# EAGLE schematic Resistor_Resistor (EAGLE 8.3.0), part 25 of 43
## Parts (continued)
R34378  10K  RESISTOR_0201  [0201]
R34379  10K  RESISTOR_0201  [0201]
R34380  10K  RESISTOR_0201  [0201]
R34381  10K  RESISTOR_0201  [0201]
R34382  10K  RESISTOR_0201  [0201]
R34383  10K  RESISTOR_0201  [0201]
R34384  10K  RESISTOR_0201  [0201]
R34385  10K  RESISTOR_0201  [0201]
R34386  10K  RESISTOR_0201  [0201]
R34387  10K  RESISTOR_0201  [0201]
R34388  10K  RESISTOR_0201  [0201]
R34389  10K  RESISTOR_0201  [0201]
R34390  10K  RESISTOR_0201  [0201]
R34391  10K  RESISTOR_0201  [0201]
R34392  10K  RESISTOR_0201  [0201]
R34393  10K  RESISTOR_0201  [0201]
R34394  10K  RESISTOR_0201  [0201]
R34395  10K  RESISTOR_0201  [0201]
R34396  10K  RESISTOR_0201  [0201]
R34397  10K  RESISTOR_0201  [0201]
R34398  10K  RESISTOR_0201  [0201]
R34399  10K  RESISTOR_0201  [0201]
R34400  10K  RESISTOR_0201  [0201]
R34401  10K  RESISTOR_0201  [0201]
R34402  10K  RESISTOR_0201  [0201]
R34403  10K  RESISTOR_0201  [0201]
R34404  10K  RESISTOR_0201  [0201]
R34405  10K  RESISTOR_0201  [0201]
R34406  10K  RESISTOR_0201  [0201]
R34407  10K  RESISTOR_0201  [0201]
R34408  10K  RESISTOR_0201  [0201]
R34409  10K  RESISTOR_0201  [0201]
R34410  10K  RESISTOR_0201  [0201]
R34411  10K  RESISTOR_0201  [0201]
R34412  10K  RESISTOR_0201  [0201]
R34413  10K  RESISTOR_0201  [0201]
R34414  10K  RESISTOR_0201  [0201]
R34415  10K  RESISTOR_0201  [0201]
R34416  10K  RESISTOR_0201  [0201]
R34417  10K  RESISTOR_0201  [0201]
R34418  10K  RESISTOR_0201  [0201]
R34419  10K  RESISTOR_0201  [0201]
R34420  10K  RESISTOR_0201  [0201]
R34421  10K  RESISTOR_0201  [0201]
R34422  10K  RESISTOR_0201  [0201]
R34423  10K  RESISTOR_0201  [0201]
R34424  10K  RESISTOR_0201  [0201]
R34425  10K  RESISTOR_0201  [0201]
R34426  10K  RESISTOR_0201  [0201]
R34427  10K  RESISTOR_0201  [0201]
R34428  10K  RESISTOR_0201  [0201]
R34429  10K  RESISTOR_0201  [0201]
R34430  10K  RESISTOR_0201  [0201]
R34431  10K  RESISTOR_0201  [0201]
R34432  10K  RESISTOR_0201  [0201]
R34433  10K  RESISTOR_0201  [0201]
R34434  10K  RESISTOR_0201  [0201]
R34435  10K  RESISTOR_0201  [0201]
R34436  10K  RESISTOR_0201  [0201]
R34437  10K  RESISTOR_0201  [0201]
R34438  10K  RESISTOR_0201  [0201]
R34439  10K  RESISTOR_0201  [0201]
R34440  10K  RESISTOR_0201  [0201]
R34441  10K  RESISTOR_0201  [0201]
R34442  10K  RESISTOR_0201  [0201]
R34443  10K  RESISTOR_0201  [0201]
R34444  10K  RESISTOR_0201  [0201]
R34445  10K  RESISTOR_0201  [0201]
R34446  10K  RESISTOR_0201  [0201]
R34447  10K  RESISTOR_0201  [0201]
R34448  10K  RESISTOR_0201  [0201]
R34449  10K  RESISTOR_0201  [0201]
R34450  10K  RESISTOR_0201  [0201]
R34451  10K  RESISTOR_0201  [0201]
R34452  10K  RESISTOR_0201  [0201]
R34453  10K  RESISTOR_0201  [0201]
R34454  10K  RESISTOR_0201  [0201]
R34455  10K  RESISTOR_0201  [0201]
R34456  10K  RESISTOR_0201  [0201]
R34457  10K  RESISTOR_0201  [0201]
R34458  10K  RESISTOR_0201  [0201]
R34459  10K  RESISTOR_0201  [0201]
R34460  10K  RESISTOR_0201  [0201]
R34461  10K  RESISTOR_0201  [0201]
R34462  10K  RESISTOR_0201  [0201]
R34463  10K  RESISTOR_0201  [0201]
R34464  10K  RESISTOR_0201  [0201]
R34465  10K  RESISTOR_0201  [0201]
R34466  10K  RESISTOR_0201  [0201]
R34467  10K  RESISTOR_0201  [0201]
R34468  10K  RESISTOR_0201  [0201]
R34469  10K  RESISTOR_0201  [0201]
R34470  10K  RESISTOR_0201  [0201]
R34471  10K  RESISTOR_0201  [0201]
R34472  10K  RESISTOR_0201  [0201]
R34473  10K  RESISTOR_0201  [0201]
R34474  10K  RESISTOR_0201  [0201]
R34475  10K  RESISTOR_0201  [0201]
R34476  10K  RESISTOR_0201  [0201]
R34477  10K  RESISTOR_0201  [0201]
R34478  10K  RESISTOR_0201  [0201]
R34479  10K  RESISTOR_0201  [0201]
R34480  10K  RESISTOR_0201  [0201]
R34481  10K  RESISTOR_0201  [0201]
R34482  10K  RESISTOR_0201  [0201]
R34483  10K  RESISTOR_0201  [0201]
R34484  10K  RESISTOR_0201  [0201]
R34485  10K  RESISTOR_0201  [0201]
R34486  10K  RESISTOR_0201  [0201]
R34487  10K  RESISTOR_0201  [0201]
R34488  10K  RESISTOR_0201  [0201]
R34489  10K  RESISTOR_0201  [0201]
R34490  10K  RESISTOR_0201  [0201]
R34491  10K  RESISTOR_0201  [0201]
R34492  10K  RESISTOR_0201  [0201]
R34493  10K  RESISTOR_0201  [0201]
R34494  10K  RESISTOR_0201  [0201]
R34495  10K  RESISTOR_0201  [0201]
R34496  10K  RESISTOR_0201  [0201]
R34497  10K  RESISTOR_0201  [0201]
R34498  10K  RESISTOR_0201  [0201]
R34499  10K  RESISTOR_0201  [0201]
R34500  10K  RESISTOR_0201  [0201]
R34501  10K  RESISTOR_0201  [0201]
R34502  10K  RESISTOR_0201  [0201]
R34503  10K  RESISTOR_0201  [0201]
R34504  10K  RESISTOR_0201  [0201]
R34505  10K  RESISTOR_0201  [0201]
R34506  10K  RESISTOR_0201  [0201]
R34507  10K  RESISTOR_0201  [0201]
R34508  10K  RESISTOR_0201  [0201]
R34509  10K  RESISTOR_0201  [0201]
R34510  10K  RESISTOR_0201  [0201]
R34511  10K  RESISTOR_0201  [0201]
R34512  10K  RESISTOR_0201  [0201]
R34513  10K  RESISTOR_0201  [0201]
R34514  10K  RESISTOR_0201  [0201]
R34515  10K  RESISTOR_0201  [0201]
R34516  10K  RESISTOR_0201  [0201]
R34517  10K  RESISTOR_0201  [0201]
R34518  10K  RESISTOR_0201  [0201]
R34519  10K  RESISTOR_0201  [0201]
R34520  10K  RESISTOR_0201  [0201]
R34521  10K  RESISTOR_0201  [0201]
R34522  10K  RESISTOR_0201  [0201]
R34523  10K  RESISTOR_0201  [0201]
R34524  10K  RESISTOR_0201  [0201]
R34525  10K  RESISTOR_0201  [0201]
R34526  10K  RESISTOR_0201  [0201]
R34527  10K  RESISTOR_0201  [0201]
R34528  10K  RESISTOR_0201  [0201]
R34529  10K  RESISTOR_0201  [0201]
R34530  10K  RESISTOR_0201  [0201]
R34531  10K  RESISTOR_0201  [0201]
R34532  10K  RESISTOR_0201  [0201]
R34533  10K  RESISTOR_0201  [0201]
R34534  10K  RESISTOR_0201  [0201]
R34535  10K  RESISTOR_0201  [0201]
R34536  10K  RESISTOR_0201  [0201]
R34537  10K  RESISTOR_0201  [0201]
R34538  10K  RESISTOR_0201  [0201]
R34539  10K  RESISTOR_0201  [0201]
R34540  10K  RESISTOR_0201  [0201]
R34541  10K  RESISTOR_0201  [0201]
R34542  10K  RESISTOR_0201  [0201]
R34543  10K  RESISTOR_0201  [0201]
R34544  10K  RESISTOR_0201  [0201]
R34545  10K  RESISTOR_0201  [0201]
R34546  10K  RESISTOR_0201  [0201]
R34547  10K  RESISTOR_0201  [0201]
R34548  10K  RESISTOR_0201  [0201]
R34549  10K  RESISTOR_0201  [0201]
R34550  10K  RESISTOR_0201  [0201]
R34551  10K  RESISTOR_0201  [0201]
R34552  10K  RESISTOR_0201  [0201]
R34553  10K  RESISTOR_0201  [0201]
R34554  10K  RESISTOR_0201  [0201]
R34555  10K  RESISTOR_0201  [0201]
R34556  10K  RESISTOR_0201  [0201]
R34557  10K  RESISTOR_0201  [0201]
R34558  10K  RESISTOR_0201  [0201]
R34559  10K  RESISTOR_0201  [0201]
R34560  10K  RESISTOR_0201  [0201]
R34561  10K  RESISTOR_0201  [0201]
R34562  10K  RESISTOR_0201  [0201]
R34563  10K  RESISTOR_0201  [0201]
R34564  10K  RESISTOR_0201  [0201]
R34565  10K  RESISTOR_0201  [0201]
R34566  10K  RESISTOR_0201  [0201]
R34567  10K  RESISTOR_0201  [0201]
R34568  10K  RESISTOR_0201  [0201]
R34569  10K  RESISTOR_0201  [0201]
R34570  10K  RESISTOR_0201  [0201]
R34571  10K  RESISTOR_0201  [0201]
R34572  10K  RESISTOR_0201  [0201]
R34573  10K  RESISTOR_0201  [0201]
R34574  10K  RESISTOR_0201  [0201]
R34575  10K  RESISTOR_0201  [0201]
R34576  10K  RESISTOR_0201  [0201]
R34577  10K  RESISTOR_0201  [0201]
R34578  10K  RESISTOR_0201  [0201]
R34579  10K  RESISTOR_0201  [0201]
R34580  10K  RESISTOR_0201  [0201]
R34581  10K  RESISTOR_0201  [0201]
R34582  10K  RESISTOR_0201  [0201]
R34583  10K  RESISTOR_0201  [0201]
R34584  10K  RESISTOR_0201  [0201]
R34585  10K  RESISTOR_0201  [0201]
R34586  10K  RESISTOR_0201  [0201]
R34587  10K  RESISTOR_0201  [0201]
R34588  10K  RESISTOR_0201  [0201]
R34589  10K  RESISTOR_0201  [0201]
R34590  10K  RESISTOR_0201  [0201]
R34591  10K  RESISTOR_0201  [0201]
R34592  10K  RESISTOR_0201  [0201]
R34593  10K  RESISTOR_0201  [0201]
R34594  10K  RESISTOR_0201  [0201]
R34595  10K  RESISTOR_0201  [0201]
R34596  10K  RESISTOR_0201  [0201]
R34597  10K  RESISTOR_0201  [0201]
R34598  10K  RESISTOR_0201  [0201]
R34599  10K  RESISTOR_0201  [0201]
R34600  10K  RESISTOR_0201  [0201]
R34601  10K  RESISTOR_0201  [0201]
R34602  10K  RESISTOR_0201  [0201]
R34603  10K  RESISTOR_0201  [0201]
R34604  10K  RESISTOR_0201  [0201]
R34605  10K  RESISTOR_0201  [0201]
R34606  10K  RESISTOR_0201  [0201]
R34607  10K  RESISTOR_0201  [0201]
R34608  10K  RESISTOR_0201  [0201]
R34609  10K  RESISTOR_0201  [0201]
R34610  10K  RESISTOR_0201  [0201]
R34611  10K  RESISTOR_0201  [0201]
R34612  10K  RESISTOR_0201  [0201]
R34613  10K  RESISTOR_0201  [0201]
R34614  10K  RESISTOR_0201  [0201]
R34615  10K  RESISTOR_0201  [0201]
R34616  10K  RESISTOR_0201  [0201]
R34617  10K  RESISTOR_0201  [0201]
R34618  10K  RESISTOR_0201  [0201]
R34619  10K  RESISTOR_0201  [0201]
R34620  10K  RESISTOR_0201  [0201]
R34621  10K  RESISTOR_0201  [0201]
R34622  10K  RESISTOR_0201  [0201]
R34623  10K  RESISTOR_0201  [0201]
R34624  10K  RESISTOR_0201  [0201]
R34625  10K  RESISTOR_0201  [0201]
R34626  10K  RESISTOR_0201  [0201]
R34627  10K  RESISTOR_0201  [0201]
R34628  10K  RESISTOR_0201  [0201]
R34629  10K  RESISTOR_0201  [0201]
R34630  10K  RESISTOR_0201  [0201]
R34631  10K  RESISTOR_0201  [0201]
R34632  10K  RESISTOR_0201  [0201]
R34633  10K  RESISTOR_0201  [0201]
R34634  10K  RESISTOR_0201  [0201]
R34635  10K  RESISTOR_0201  [0201]
R34636  10K  RESISTOR_0201  [0201]
R34637  10K  RESISTOR_0201  [0201]
R34638  10K  RESISTOR_0201  [0201]
R34639  10K  RESISTOR_0201  [0201]
R34640  10K  RESISTOR_0201  [0201]
R34641  10K  RESISTOR_0201  [0201]
R34642  10K  RESISTOR_0201  [0201]
R34643  10K  RESISTOR_0201  [0201]
R34644  10K  RESISTOR_0201  [0201]
R34645  10K  RESISTOR_0201  [0201]
R34646  10K  RESISTOR_0201  [0201]
R34647  10K  RESISTOR_0201  [0201]
R34648  10K  RESISTOR_0201  [0201]
R34649  10K  RESISTOR_0201  [0201]
R34650  10K  RESISTOR_0201  [0201]
R34651  10K  RESISTOR_0201  [0201]
R34652  10K  RESISTOR_0201  [0201]
R34653  10K  RESISTOR_0201  [0201]
R34654  10K  RESISTOR_0201  [0201]
R34655  10K  RESISTOR_0201  [0201]
R34656  10K  RESISTOR_0201  [0201]
R34657  10K  RESISTOR_0201  [0201]
R34658  10K  RESISTOR_0201  [0201]
R34659  10K  RESISTOR_0201  [0201]
R34660  10K  RESISTOR_0201  [0201]
R34661  10K  RESISTOR_0201  [0201]
R34662  10K  RESISTOR_0201  [0201]
R34663  10K  RESISTOR_0201  [0201]
R34664  10K  RESISTOR_0201  [0201]
R34665  10K  RESISTOR_0201  [0201]
R34666  10K  RESISTOR_0201  [0201]
R34667  10K  RESISTOR_0201  [0201]
R34668  10K  RESISTOR_0201  [0201]
R34669  10K  RESISTOR_0201  [0201]
R34670  10K  RESISTOR_0201  [0201]
R34671  10K  RESISTOR_0201  [0201]
R34672  10K  RESISTOR_0201  [0201]
R34673  10K  RESISTOR_0201  [0201]
R34674  10K  RESISTOR_0201  [0201]
R34675  10K  RESISTOR_0201  [0201]
R34676  10K  RESISTOR_0201  [0201]
R34677  10K  RESISTOR_0201  [0201]
R34678  10K  RESISTOR_0201  [0201]
R34679  10K  RESISTOR_0201  [0201]
R34680  10K  RESISTOR_0201  [0201]
R34681  10K  RESISTOR_0201  [0201]
R34682  10K  RESISTOR_0201  [0201]
R34683  10K  RESISTOR_0201  [0201]
R34684  10K  RESISTOR_0201  [0201]
R34685  10K  RESISTOR_0201  [0201]
R34686  10K  RESISTOR_0201  [0201]
R34687  10K  RESISTOR_0201  [0201]
R34688  10K  RESISTOR_0201  [0201]
R34689  10K  RESISTOR_0201  [0201]
R34690  10K  RESISTOR_0201  [0201]
R34691  10K  RESISTOR_0201  [0201]
R34692  10K  RESISTOR_0201  [0201]
R34693  10K  RESISTOR_0201  [0201]
R34694  10K  RESISTOR_0201  [0201]
R34695  10K  RESISTOR_0201  [0201]
R34696  10K  RESISTOR_0201  [0201]
R34697  10K  RESISTOR_0201  [0201]
R34698  10K  RESISTOR_0201  [0201]
R34699  10K  RESISTOR_0201  [0201]
R34700  10K  RESISTOR_0201  [0201]
R34701  10K  RESISTOR_0201  [0201]
R34702  10K  RESISTOR_0201  [0201]
R34703  10K  RESISTOR_0201  [0201]
R34704  10K  RESISTOR_0201  [0201]
R34705  10K  RESISTOR_0201  [0201]
R34706  10K  RESISTOR_0201  [0201]
R34707  10K  RESISTOR_0201  [0201]
R34708  10K  RESISTOR_0201  [0201]
R34709  10K  RESISTOR_0201  [0201]
R34710  10K  RESISTOR_0201  [0201]
R34711  10K  RESISTOR_0201  [0201]
R34712  10K  RESISTOR_0201  [0201]
R34713  10K  RESISTOR_0201  [0201]
R34714  10K  RESISTOR_0201  [0201]
R34715  10K  RESISTOR_0201  [0201]
R34716  10K  RESISTOR_0201  [0201]
R34717  10K  RESISTOR_0201  [0201]
R34718  10K  RESISTOR_0201  [0201]
R34719  10K  RESISTOR_0201  [0201]
R34720  10K  RESISTOR_0201  [0201]
R34721  10K  RESISTOR_0201  [0201]
R34722  10K  RESISTOR_0201  [0201]
R34723  10K  RESISTOR_0201  [0201]
R34724  10K  RESISTOR_0201  [0201]
R34725  10K  RESISTOR_0201  [0201]
R34726  10K  RESISTOR_0201  [0201]
R34727  10K  RESISTOR_0201  [0201]
R34728  10K  RESISTOR_0201  [0201]
R34729  10K  RESISTOR_0201  [0201]
R34730  10K  RESISTOR_0201  [0201]
R34731  10K  RESISTOR_0201  [0201]
R34732  10K  RESISTOR_0201  [0201]
R34733  10K  RESISTOR_0201  [0201]
R34734  10K  RESISTOR_0201  [0201]
R34735  10K  RESISTOR_0201  [0201]
R34736  10K  RESISTOR_0201  [0201]
R34737  10K  RESISTOR_0201  [0201]
R34738  10K  RESISTOR_0201  [0201]
R34739  10K  RESISTOR_0201  [0201]
R34740  10K  RESISTOR_0201  [0201]
R34741  10K  RESISTOR_0201  [0201]
R34742  10K  RESISTOR_0201  [0201]
R34743  10K  RESISTOR_0201  [0201]
R34744  10K  RESISTOR_0201  [0201]
R34745  10K  RESISTOR_0201  [0201]
R34746  10K  RESISTOR_0201  [0201]
R34747  10K  RESISTOR_0201  [0201]
R34748  10K  RESISTOR_0201  [0201]
R34749  10K  RESISTOR_0201  [0201]
R34750  10K  RESISTOR_0201  [0201]
R34751  10K  RESISTOR_0201  [0201]
R34752  10K  RESISTOR_0201  [0201]
R34753  10K  RESISTOR_0201  [0201]
R34754  10K  RESISTOR_0201  [0201]
R34755  10K  RESISTOR_0201  [0201]
R34756  10K  RESISTOR_0201  [0201]
R34757  10K  RESISTOR_0201  [0201]
R34758  10K  RESISTOR_0201  [0201]
R34759  10K  RESISTOR_0201  [0201]
R34760  10K  RESISTOR_0201  [0201]
R34761  10K  RESISTOR_0201  [0201]
R34762  10K  RESISTOR_0201  [0201]
R34763  10K  RESISTOR_0201  [0201]
R34764  10K  RESISTOR_0201  [0201]
R34765  10K  RESISTOR_0201  [0201]
R34766  10K  RESISTOR_0201  [0201]
R34767  10K  RESISTOR_0201  [0201]
R34768  10K  RESISTOR_0201  [0201]
R34769  10K  RESISTOR_0201  [0201]
R34770  10K  RESISTOR_0201  [0201]
R34771  10K  RESISTOR_0201  [0201]
R34772  10K  RESISTOR_0201  [0201]
R34773  10K  RESISTOR_0201  [0201]
R34774  10K  RESISTOR_0201  [0201]
R34775  10K  RESISTOR_0201  [0201]
R34776  10K  RESISTOR_0201  [0201]
R34777  10K  RESISTOR_0201  [0201]
R34778  10K  RESISTOR_0201  [0201]
R34779  10K  RESISTOR_0201  [0201]
R34780  10K  RESISTOR_0201  [0201]
R34781  10K  RESISTOR_0201  [0201]
R34782  10K  RESISTOR_0201  [0201]
R34783  10K  RESISTOR_0201  [0201]
R34784  10K  RESISTOR_0201  [0201]
R34785  10K  RESISTOR_0201  [0201]
R34786  10K  RESISTOR_0201  [0201]
R34787  10K  RESISTOR_0201  [0201]
R34788  10K  RESISTOR_0201  [0201]
R34789  10K  RESISTOR_0201  [0201]
R34790  10K  RESISTOR_0201  [0201]
R34791  10K  RESISTOR_0201  [0201]
R34792  10K  RESISTOR_0201  [0201]
R34793  10K  RESISTOR_0201  [0201]
R34794  10K  RESISTOR_0201  [0201]
R34795  10K  RESISTOR_0201  [0201]
R34796  10K  RESISTOR_0201  [0201]
R34797  10K  RESISTOR_0201  [0201]
R34798  10K  RESISTOR_0201  [0201]
R34799  10K  RESISTOR_0201  [0201]
R34800  10K  RESISTOR_0201  [0201]
R34801  10K  RESISTOR_0201  [0201]
R34802  10K  RESISTOR_0201  [0201]
R34803  10K  RESISTOR_0201  [0201]
R34804  10K  RESISTOR_0201  [0201]
R34805  10K  RESISTOR_0201  [0201]
R34806  10K  RESISTOR_0201  [0201]
R34807  10K  RESISTOR_0201  [0201]
R34808  10K  RESISTOR_0201  [0201]
R34809  10K  RESISTOR_0201  [0201]
R34810  10K  RESISTOR_0201  [0201]
R34811  10K  RESISTOR_0201  [0201]
R34812  10K  RESISTOR_0201  [0201]
R34813  10K  RESISTOR_0201  [0201]
R34814  10K  RESISTOR_0201  [0201]
R34815  10K  RESISTOR_0201  [0201]
R34816  10K  RESISTOR_0201  [0201]
R34817  10K  RESISTOR_0201  [0201]
R34818  10K  RESISTOR_0201  [0201]
R34819  10K  RESISTOR_0201  [0201]
R34820  10K  RESISTOR_0201  [0201]
R34821  10K  RESISTOR_0201  [0201]
R34822  10K  RESISTOR_0201  [0201]
R34823  10K  RESISTOR_0201  [0201]
R34824  10K  RESISTOR_0201  [0201]
R34825  10K  RESISTOR_0201  [0201]
R34826  10K  RESISTOR_0201  [0201]
R34827  10K  RESISTOR_0201  [0201]
R34828  10K  RESISTOR_0201  [0201]
R34829  10K  RESISTOR_0201  [0201]
R34830  10K  RESISTOR_0201  [0201]
R34831  10K  RESISTOR_0201  [0201]
R34832  10K  RESISTOR_0201  [0201]
R34833  10K  RESISTOR_0201  [0201]
R34834  10K  RESISTOR_0201  [0201]
R34835  10K  RESISTOR_0201  [0201]
R34836  10K  RESISTOR_0201  [0201]
R34837  10K  RESISTOR_0201  [0201]
R34838  10K  RESISTOR_0201  [0201]
R34839  10K  RESISTOR_0201  [0201]
R34840  10K  RESISTOR_0201  [0201]
R34841  10K  RESISTOR_0201  [0201]
R34842  10K  RESISTOR_0201  [0201]
R34843  10K  RESISTOR_0201  [0201]
R34844  10K  RESISTOR_0201  [0201]
R34845  10K  RESISTOR_0201  [0201]
R34846  10K  RESISTOR_0201  [0201]
R34847  10K  RESISTOR_0201  [0201]
R34848  10K  RESISTOR_0201  [0201]
R34849  10K  RESISTOR_0201  [0201]
R34850  10K  RESISTOR_0201  [0201]
R34851  10K  RESISTOR_0201  [0201]
R34852  10K  RESISTOR_0201  [0201]
R34853  10K  RESISTOR_0201  [0201]
R34854  10K  RESISTOR_0201  [0201]
R34855  10K  RESISTOR_0201  [0201]
R34856  10K  RESISTOR_0201  [0201]
R34857  10K  RESISTOR_0201  [0201]
R34858  10K  RESISTOR_0201  [0201]
R34859  10K  RESISTOR_0201  [0201]
R34860  10K  RESISTOR_0201  [0201]
R34861  10K  RESISTOR_0201  [0201]
R34862  10K  RESISTOR_0201  [0201]
R34863  10K  RESISTOR_0201  [0201]
R34864  10K  RESISTOR_0201  [0201]
R34865  10K  RESISTOR_0201  [0201]
R34866  10K  RESISTOR_0201  [0201]
R34867  10K  RESISTOR_0201  [0201]
R34868  10K  RESISTOR_0201  [0201]
R34869  10K  RESISTOR_0201  [0201]
R34870  10K  RESISTOR_0201  [0201]
R34871  10K  RESISTOR_0201  [0201]
R34872  10K  RESISTOR_0201  [0201]
R34873  10K  RESISTOR_0201  [0201]
R34874  10K  RESISTOR_0201  [0201]
R34875  10K  RESISTOR_0201  [0201]
R34876  10K  RESISTOR_0201  [0201]
R34877  10K  RESISTOR_0201  [0201]
R34878  10K  RESISTOR_0201  [0201]
R34879  10K  RESISTOR_0201  [0201]
R34880  10K  RESISTOR_0201  [0201]
R34881  10K  RESISTOR_0201  [0201]
R34882  10K  RESISTOR_0201  [0201]
R34883  10K  RESISTOR_0201  [0201]
R34884  10K  RESISTOR_0201  [0201]
R34885  10K  RESISTOR_0201  [0201]
R34886  10K  RESISTOR_0201  [0201]
R34887  10K  RESISTOR_0201  [0201]
R34888  10K  RESISTOR_0201  [0201]
R34889  10K  RESISTOR_0201  [0201]
R34890  10K  RESISTOR_0201  [0201]
R34891  10K  RESISTOR_0201  [0201]
R34892  10K  RESISTOR_0201  [0201]
R34893  10K  RESISTOR_0201  [0201]
R34894  10K  RESISTOR_0201  [0201]
R34895  10K  RESISTOR_0201  [0201]
R34896  10K  RESISTOR_0201  [0201]
R34897  10K  RESISTOR_0201  [0201]
R34898  10K  RESISTOR_0201  [0201]
R34899  10K  RESISTOR_0201  [0201]
R34900  10K  RESISTOR_0201  [0201]
R34901  10K  RESISTOR_0201  [0201]
R34902  10K  RESISTOR_0201  [0201]
R34903  10K  RESISTOR_0201  [0201]
R34904  10K  RESISTOR_0201  [0201]
R34905  10K  RESISTOR_0201  [0201]
R34906  10K  RESISTOR_0201  [0201]
R34907  10K  RESISTOR_0201  [0201]
R34908  10K  RESISTOR_0201  [0201]
R34909  10K  RESISTOR_0201  [0201]
R34910  10K  RESISTOR_0201  [0201]
R34911  10K  RESISTOR_0201  [0201]
R34912  10K  RESISTOR_0201  [0201]
R34913  10K  RESISTOR_0201  [0201]
R34914  10K  RESISTOR_0201  [0201]
R34915  10K  RESISTOR_0201  [0201]
R34916  10K  RESISTOR_0201  [0201]
R34917  10K  RESISTOR_0201  [0201]
R34918  10K  RESISTOR_0201  [0201]
R34919  10K  RESISTOR_0201  [0201]
R34920  10K  RESISTOR_0201  [0201]
R34921  10K  RESISTOR_0201  [0201]
R34922  10K  RESISTOR_0201  [0201]
R34923  10K  RESISTOR_0201  [0201]
R34924  10K  RESISTOR_0201  [0201]
R34925  10K  RESISTOR_0201  [0201]
R34926  10K  RESISTOR_0201  [0201]
R34927  10K  RESISTOR_0201  [0201]
R34928  10K  RESISTOR_0201  [0201]
R34929  10K  RESISTOR_0201  [0201]
R34930  10K  RESISTOR_0201  [0201]
R34931  10K  RESISTOR_0201  [0201]
R34932  10K  RESISTOR_0201  [0201]
R34933  10K  RESISTOR_0201  [0201]
R34934  10K  RESISTOR_0201  [0201]
R34935  10K  RESISTOR_0201  [0201]
R34936  10K  RESISTOR_0201  [0201]
R34937  10K  RESISTOR_0201  [0201]
R34938  10K  RESISTOR_0201  [0201]
R34939  10K  RESISTOR_0201  [0201]
R34940  10K  RESISTOR_0201  [0201]
R34941  10K  RESISTOR_0201  [0201]
R34942  10K  RESISTOR_0201  [0201]
R34943  10K  RESISTOR_0201  [0201]
R34944  10K  RESISTOR_0201  [0201]
R34945  10K  RESISTOR_0201  [0201]
R34946  10K  RESISTOR_0201  [0201]
R34947  10K  RESISTOR_0201  [0201]
R34948  10K  RESISTOR_0201  [0201]
R34949  10K  RESISTOR_0201  [0201]
R34950  10K  RESISTOR_0201  [0201]
R34951  10K  RESISTOR_0201  [0201]
R34952  10K  RESISTOR_0201  [0201]
R34953  10K  RESISTOR_0201  [0201]
R34954  10K  RESISTOR_0201  [0201]
R34955  10K  RESISTOR_0201  [0201]
R34956  10K  RESISTOR_0201  [0201]
R34957  10K  RESISTOR_0201  [0201]
R34958  10K  RESISTOR_0201  [0201]
R34959  10K  RESISTOR_0201  [0201]
R34960  10K  RESISTOR_0201  [0201]
R34961  10K  RESISTOR_0201  [0201]
R34962  10K  RESISTOR_0201  [0201]
R34963  10K  RESISTOR_0201  [0201]
R34964  10K  RESISTOR_0201  [0201]
R34965  10K  RESISTOR_0201  [0201]
R34966  10K  RESISTOR_0201  [0201]
R34967  10K  RESISTOR_0201  [0201]
R34968  10K  RESISTOR_0201  [0201]
R34969  10K  RESISTOR_0201  [0201]
R34970  10K  RESISTOR_0201  [0201]
R34971  10K  RESISTOR_0201  [0201]
R34972  10K  RESISTOR_0201  [0201]
R34973  10K  RESISTOR_0201  [0201]
R34974  10K  RESISTOR_0201  [0201]
R34975  10K  RESISTOR_0201  [0201]
R34976  10K  RESISTOR_0201  [0201]
R34977  10K  RESISTOR_0201  [0201]
R34978  10K  RESISTOR_0201  [0201]
R34979  10K  RESISTOR_0201  [0201]
R34980  10K  RESISTOR_0201  [0201]
R34981  10K  RESISTOR_0201  [0201]
R34982  10K  RESISTOR_0201  [0201]
R34983  10K  RESISTOR_0201  [0201]
R34984  10K  RESISTOR_0201  [0201]
R34985  10K  RESISTOR_0201  [0201]
R34986  10K  RESISTOR_0201  [0201]
R34987  10K  RESISTOR_0201  [0201]
R34988  10K  RESISTOR_0201  [0201]
R34989  10K  RESISTOR_0201  [0201]
R34990  10K  RESISTOR_0201  [0201]
R34991  10K  RESISTOR_0201  [0201]
R34992  10K  RESISTOR_0201  [0201]
R34993  10K  RESISTOR_0201  [0201]
R34994  10K  RESISTOR_0201  [0201]
R34995  10K  RESISTOR_0201  [0201]
R34996  10K  RESISTOR_0201  [0201]
R34997  10K  RESISTOR_0201  [0201]
R34998  10K  RESISTOR_0201  [0201]
R34999  10K  RESISTOR_0201  [0201]
R35000  10K  RESISTOR_0201  [0201]
R35001  10K  RESISTOR_0201  [0201]
R35002  10K  RESISTOR_0201  [0201]
R35003  10K  RESISTOR_0201  [0201]
R35004  10K  RESISTOR_0201  [0201]
R35005  10K  RESISTOR_0201  [0201]
R35006  10K  RESISTOR_0201  [0201]
R35007  10K  RESISTOR_0201  [0201]
R35008  10K  RESISTOR_0201  [0201]
R35009  10K  RESISTOR_0201  [0201]
R35010  10K  RESISTOR_0201  [0201]
R35011  10K  RESISTOR_0201  [0201]
R35012  10K  RESISTOR_0201  [0201]
R35013  10K  RESISTOR_0201  [0201]
R35014  10K  RESISTOR_0201  [0201]
R35015  10K  RESISTOR_0201  [0201]
R35016  10K  RESISTOR_0201  [0201]
R35017  10K  RESISTOR_0201  [0201]
R35018  10K  RESISTOR_0201  [0201]
R35019  10K  RESISTOR_0201  [0201]
R35020  10K  RESISTOR_0201  [0201]
R35021  10K  RESISTOR_0201  [0201]
R35022  10K  RESISTOR_0201  [0201]
R35023  10K  RESISTOR_0201  [0201]
R35024  10K  RESISTOR_0201  [0201]
R35025  10K  RESISTOR_0201  [0201]
R35026  10K  RESISTOR_0201  [0201]
R35027  10K  RESISTOR_0201  [0201]
R35028  10K  RESISTOR_0201  [0201]
R35029  10K  RESISTOR_0201  [0201]
R35030  10K  RESISTOR_0201  [0201]
R35031  10K  RESISTOR_0201  [0201]
R35032  10K  RESISTOR_0201  [0201]
R35033  10K  RESISTOR_0201  [0201]
R35034  10K  RESISTOR_0201  [0201]
R35035  10K  RESISTOR_0201  [0201]
R35036  10K  RESISTOR_0201  [0201]
R35037  10K  RESISTOR_0201  [0201]
R35038  10K  RESISTOR_0201  [0201]
R35039  10K  RESISTOR_0201  [0201]
R35040  10K  RESISTOR_0201  [0201]
R35041  10K  RESISTOR_0201  [0201]
R35042  10K  RESISTOR_0201  [0201]
R35043  10K  RESISTOR_0201  [0201]
R35044  10K  RESISTOR_0201  [0201]
R35045  10K  RESISTOR_0201  [0201]
R35046  10K  RESISTOR_0201  [0201]
R35047  10K  RESISTOR_0201  [0201]
R35048  10K  RESISTOR_0201  [0201]
R35049  10K  RESISTOR_0201  [0201]
R35050  10K  RESISTOR_0201  [0201]
R35051  10K  RESISTOR_0201  [0201]
R35052  10K  RESISTOR_0201  [0201]
R35053  10K  RESISTOR_0201  [0201]
R35054  10K  RESISTOR_0201  [0201]
R35055  10K  RESISTOR_0201  [0201]
R35056  10K  RESISTOR_0201  [0201]
R35057  10K  RESISTOR_0201  [0201]
R35058  10K  RESISTOR_0201  [0201]
R35059  10K  RESISTOR_0201  [0201]
R35060  10K  RESISTOR_0201  [0201]
R35061  10K  RESISTOR_0201  [0201]
R35062  10K  RESISTOR_0201  [0201]
R35063  10K  RESISTOR_0201  [0201]
R35064  10K  RESISTOR_0201  [0201]
R35065  10K  RESISTOR_0201  [0201]
R35066  10K  RESISTOR_0201  [0201]
R35067  10K  RESISTOR_0201  [0201]
R35068  10K  RESISTOR_0201  [0201]
R35069  10K  RESISTOR_0201  [0201]
R35070  10K  RESISTOR_0201  [0201]
R35071  10K  RESISTOR_0201  [0201]
R35072  10K  RESISTOR_0201  [0201]
R35073  10K  RESISTOR_0201  [0201]
R35074  10K  RESISTOR_0201  [0201]
R35075  10K  RESISTOR_0201  [0201]
R35076  10K  RESISTOR_0201  [0201]
R35077  10K  RESISTOR_0201  [0201]
R35078  10K  RESISTOR_0201  [0201]
R35079  10K  RESISTOR_0201  [0201]
R35080  10K  RESISTOR_0201  [0201]
R35081  10K  RESISTOR_0201  [0201]
R35082  10K  RESISTOR_0201  [0201]
R35083  10K  RESISTOR_0201  [0201]
R35084  10K  RESISTOR_0201  [0201]
R35085  10K  RESISTOR_0201  [0201]
R35086  10K  RESISTOR_0201  [0201]
R35087  10K  RESISTOR_0201  [0201]
R35088  10K  RESISTOR_0201  [0201]
R35089  10K  RESISTOR_0201  [0201]
R35090  10K  RESISTOR_0201  [0201]
R35091  10K  RESISTOR_0201  [0201]
R35092  10K  RESISTOR_0201  [0201]
R35093  10K  RESISTOR_0201  [0201]
R35094  10K  RESISTOR_0201  [0201]
R35095  10K  RESISTOR_0201  [0201]
R35096  10K  RESISTOR_0201  [0201]
R35097  10K  RESISTOR_0201  [0201]
R35098  10K  RESISTOR_0201  [0201]
R35099  10K  RESISTOR_0201  [0201]
R35100  10K  RESISTOR_0201  [0201]
R35101  10K  RESISTOR_0201  [0201]
R35102  10K  RESISTOR_0201  [0201]
R35103  10K  RESISTOR_0201  [0201]
R35104  10K  RESISTOR_0201  [0201]
R35105  10K  RESISTOR_0201  [0201]
R35106  10K  RESISTOR_0201  [0201]
R35107  10K  RESISTOR_0201  [0201]
R35108  10K  RESISTOR_0201  [0201]
R35109  10K  RESISTOR_0201  [0201]
R35110  10K  RESISTOR_0201  [0201]
R35111  10K  RESISTOR_0201  [0201]
R35112  10K  RESISTOR_0201  [0201]
R35113  10K  RESISTOR_0201  [0201]
R35114  10K  RESISTOR_0201  [0201]
R35115  10K  RESISTOR_0201  [0201]
R35116  10K  RESISTOR_0201  [0201]
R35117  10K  RESISTOR_0201  [0201]
R35118  10K  RESISTOR_0201  [0201]
R35119  10K  RESISTOR_0201  [0201]
R35120  10K  RESISTOR_0201  [0201]
R35121  10K  RESISTOR_0201  [0201]
R35122  10K  RESISTOR_0201  [0201]
R35123  10K  RESISTOR_0201  [0201]
R35124  10K  RESISTOR_0201  [0201]
R35125  10K  RESISTOR_0201  [0201]
R35126  10K  RESISTOR_0201  [0201]
R35127  10K  RESISTOR_0201  [0201]
R35128  10K  RESISTOR_0201  [0201]
R35129  10K  RESISTOR_0201  [0201]
R35130  10K  RESISTOR_0201  [0201]
R35131  10K  RESISTOR_0201  [0201]
R35132  10K  RESISTOR_0201  [0201]
R35133  10K  RESISTOR_0201  [0201]
R35134  10K  RESISTOR_0201  [0201]
R35135  10K  RESISTOR_0201  [0201]
R35136  10K  RESISTOR_0201  [0201]
R35137  10K  RESISTOR_0201  [0201]
R35138  10K  RESISTOR_0201  [0201]
R35139  10K  RESISTOR_0201  [0201]
R35140  10K  RESISTOR_0201  [0201]
R35141  10K  RESISTOR_0201  [0201]
R35142  10K  RESISTOR_0201  [0201]
R35143  10K  RESISTOR_0201  [0201]
R35144  10K  RESISTOR_0201  [0201]
R35145  10K  RESISTOR_0201  [0201]
R35146  10K  RESISTOR_0201  [0201]
R35147  10K  RESISTOR_0201  [0201]
R35148  10K  RESISTOR_0201  [0201]
R35149  10K  RESISTOR_0201  [0201]
R35150  10K  RESISTOR_0201  [0201]
R35151  10K  RESISTOR_0201  [0201]
R35152  10K  RESISTOR_0201  [0201]
R35153  10K  RESISTOR_0201  [0201]
R35154  10K  RESISTOR_0201  [0201]
R35155  10K  RESISTOR_0201  [0201]
R35156  10K  RESISTOR_0201  [0201]
R35157  10K  RESISTOR_0201  [0201]
R35158  10K  RESISTOR_0201  [0201]
R35159  10K  RESISTOR_0201  [0201]
R35160  10K  RESISTOR_0201  [0201]
R35161  10K  RESISTOR_0201  [0201]
R35162  10K  RESISTOR_0201  [0201]
R35163  10K  RESISTOR_0201  [0201]
R35164  10K  RESISTOR_0201  [0201]
R35165  10K  RESISTOR_0201  [0201]
R35166  10K  RESISTOR_0201  [0201]
R35167  10K  RESISTOR_0201  [0201]
R35168  10K  RESISTOR_0201  [0201]
R35169  10K  RESISTOR_0201  [0201]
R35170  10K  RESISTOR_0201  [0201]
R35171  10K  RESISTOR_0201  [0201]
R35172  10K  RESISTOR_0201  [0201]
R35173  10K  RESISTOR_0201  [0201]
R35174  10K  RESISTOR_0201  [0201]
R35175  10K  RESISTOR_0201  [0201]
R35176  10K  RESISTOR_0201  [0201]
R35177  10K  RESISTOR_0201  [0201]
R35178  10K  RESISTOR_0201  [0201]
R35179  10K  RESISTOR_0201  [0201]
R35180  10K  RESISTOR_0201  [0201]
R35181  10K  RESISTOR_0201  [0201]
R35182  10K  RESISTOR_0201  [0201]
R35183  10K  RESISTOR_0201  [0201]
R35184  10K  RESISTOR_0201  [0201]
R35185  10K  RESISTOR_0201  [0201]
R35186  10K  RESISTOR_0201  [0201]
R35187  10K  RESISTOR_0201  [0201]
R35188  10K  RESISTOR_0201  [0201]
R35189  10K  RESISTOR_0201  [0201]
R35190  10K  RESISTOR_0201  [0201]
R35191  10K  RESISTOR_0201  [0201]
R35192  10K  RESISTOR_0201  [0201]
R35193  10K  RESISTOR_0201  [0201]
R35194  10K  RESISTOR_0201  [0201]
R35195  10K  RESISTOR_0201  [0201]
R35196  10K  RESISTOR_0201  [0201]
R35197  10K  RESISTOR_0201  [0201]
R35198  10K  RESISTOR_0201  [0201]
R35199  10K  RESISTOR_0201  [0201]
R35200  10K  RESISTOR_0201  [0201]
R35201  10K  RESISTOR_0201  [0201]
R35202  10K  RESISTOR_0201  [0201]
R35203  10K  RESISTOR_0201  [0201]
R35204  10K  RESISTOR_0201  [0201]
R35205  10K  RESISTOR_0201  [0201]
R35206  10K  RESISTOR_0201  [0201]
R35207  10K  RESISTOR_0201  [0201]
R35208  10K  RESISTOR_0201  [0201]
R35209  10K  RESISTOR_0201  [0201]
R35210  10K  RESISTOR_0201  [0201]
R35211  10K  RESISTOR_0201  [0201]
R35212  10K  RESISTOR_0201  [0201]
R35213  10K  RESISTOR_0201  [0201]
R35214  10K  RESISTOR_0201  [0201]
R35215  10K  RESISTOR_0201  [0201]
R35216  10K  RESISTOR_0201  [0201]
R35217  10K  RESISTOR_0201  [0201]
R35218  10K  RESISTOR_0201  [0201]
R35219  10K  RESISTOR_0201  [0201]
R35220  10K  RESISTOR_0201  [0201]
R35221  10K  RESISTOR_0201  [0201]
R35222  10K  RESISTOR_0201  [0201]
R35223  10K  RESISTOR_0201  [0201]
R35224  10K  RESISTOR_0201  [0201]
R35225  10K  RESISTOR_0201  [0201]
R35226  10K  RESISTOR_0201  [0201]
R35227  10K  RESISTOR_0201  [0201]
R35228  10K  RESISTOR_0201  [0201]
R35229  10K  RESISTOR_0201  [0201]
R35230  10K  RESISTOR_0201  [0201]
R35231  10K  RESISTOR_0201  [0201]
R35232  10K  RESISTOR_0201  [0201]
R35233  10K  RESISTOR_0201  [0201]
R35234  10K  RESISTOR_0201  [0201]
R35235  10K  RESISTOR_0201  [0201]
R35236  10K  RESISTOR_0201  [0201]
R35237  10K  RESISTOR_0201  [0201]
R35238  10K  RESISTOR_0201  [0201]
R35239  10K  RESISTOR_0201  [0201]
R35240  10K  RESISTOR_0201  [0201]
R35241  10K  RESISTOR_0201  [0201]
R35242  10K  RESISTOR_0201  [0201]
R35243  10K  RESISTOR_0201  [0201]
R35244  10K  RESISTOR_0201  [0201]
R35245  10K  RESISTOR_0201  [0201]
R35246  10K  RESISTOR_0201  [0201]
R35247  10K  RESISTOR_0201  [0201]
R35248  10K  RESISTOR_0201  [0201]
R35249  10K  RESISTOR_0201  [0201]
R35250  10K  RESISTOR_0201  [0201]
R35251  10K  RESISTOR_0201  [0201]
R35252  10K  RESISTOR_0201  [0201]
R35253  10K  RESISTOR_0201  [0201]
R35254  10K  RESISTOR_0201  [0201]
R35255  10K  RESISTOR_0201  [0201]
R35256  10K  RESISTOR_0201  [0201]
R35257  10K  RESISTOR_0201  [0201]
R35258  10K  RESISTOR_0201  [0201]
R35259  10K  RESISTOR_0201  [0201]
R35260  10K  RESISTOR_0201  [0201]
R35261  10K  RESISTOR_0201  [0201]
R35262  10K  RESISTOR_0201  [0201]
R35263  10K  RESISTOR_0201  [0201]
R35264  10K  RESISTOR_0201  [0201]
R35265  10K  RESISTOR_0201  [0201]
R35266  10K  RESISTOR_0201  [0201]
R35267  10K  RESISTOR_0201  [0201]
R35268  10K  RESISTOR_0201  [0201]
R35269  10K  RESISTOR_0201  [0201]
R35270  10K  RESISTOR_0201  [0201]
R35271  10K  RESISTOR_0201  [0201]
R35272  10K  RESISTOR_0201  [0201]
R35273  10K  RESISTOR_0201  [0201]
R35274  10K  RESISTOR_0201  [0201]
R35275  10K  RESISTOR_0201  [0201]
R35276  10K  RESISTOR_0201  [0201]
R35277  10K  RESISTOR_0201  [0201]
R35278  10K  RESISTOR_0201  [0201]
R35279  10K  RESISTOR_0201  [0201]
R35280  10K  RESISTOR_0201  [0201]
R35281  10K  RESISTOR_0201  [0201]
R35282  10K  RESISTOR_0201  [0201]
R35283  10K  RESISTOR_0201  [0201]
R35284  10K  RESISTOR_0201  [0201]
R35285  10K  RESISTOR_0201  [0201]
R35286  10K  RESISTOR_0201  [0201]
R35287  10K  RESISTOR_0201  [0201]
R35288  10K  RESISTOR_0201  [0201]
R35289  10K  RESISTOR_0201  [0201]
R35290  10K  RESISTOR_0201  [0201]
R35291  10K  RESISTOR_0201  [0201]
R35292  10K  RESISTOR_0201  [0201]
R35293  10K  RESISTOR_0201  [0201]
R35294  10K  RESISTOR_0201  [0201]
R35295  10K  RESISTOR_0201  [0201]
R35296  10K  RESISTOR_0201  [0201]
R35297  10K  RESISTOR_0201  [0201]
R35298  10K  RESISTOR_0201  [0201]
R35299  10K  RESISTOR_0201  [0201]
R35300  10K  RESISTOR_0201  [0201]
R35301  10K  RESISTOR_0201  [0201]
R35302  10K  RESISTOR_0201  [0201]
R35303  10K  RESISTOR_0201  [0201]
R35304  10K  RESISTOR_0201  [0201]
R35305  10K  RESISTOR_0201  [0201]
R35306  10K  RESISTOR_0201  [0201]
R35307  10K  RESISTOR_0201  [0201]
R35308  10K  RESISTOR_0201  [0201]
R35309  10K  RESISTOR_0201  [0201]
R35310  10K  RESISTOR_0201  [0201]
R35311  10K  RESISTOR_0201  [0201]
R35312  10K  RESISTOR_0201  [0201]
R35313  10K  RESISTOR_0201  [0201]
R35314  10K  RESISTOR_0201  [0201]
R35315  10K  RESISTOR_0201  [0201]
R35316  10K  RESISTOR_0201  [0201]
R35317  10K  RESISTOR_0201  [0201]
R35318  10K  RESISTOR_0201  [0201]
R35319  10K  RESISTOR_0201  [0201]
R35320  10K  RESISTOR_0201  [0201]
R35321  10K  RESISTOR_0201  [0201]
R35322  10K  RESISTOR_0201  [0201]
R35323  10K  RESISTOR_0201  [0201]
R35324  10K  RESISTOR_0201  [0201]
R35325  10K  RESISTOR_0201  [0201]
R35326  10K  RESISTOR_0201  [0201]
R35327  10K  RESISTOR_0201  [0201]
R35328  10K  RESISTOR_0201  [0201]
R35329  10K  RESISTOR_0201  [0201]
R35330  10K  RESISTOR_0201  [0201]
R35331  10K  RESISTOR_0201  [0201]
R35332  10K  RESISTOR_0201  [0201]
R35333  10K  RESISTOR_0201  [0201]
R35334  10K  RESISTOR_0201  [0201]
R35335  10K  RESISTOR_0201  [0201]
R35336  10K  RESISTOR_0201  [0201]
R35337  10K  RESISTOR_0201  [0201]
R35338  10K  RESISTOR_0201  [0201]
R35339  10K  RESISTOR_0201  [0201]
R35340  10K  RESISTOR_0201  [0201]
R35341  10K  RESISTOR_0201  [0201]
R35342  10K  RESISTOR_0201  [0201]
R35343  10K  RESISTOR_0201  [0201]
R35344  10K  RESISTOR_0201  [0201]
R35345  10K  RESISTOR_0201  [0201]
R35346  10K  RESISTOR_0201  [0201]
R35347  10K  RESISTOR_0201  [0201]
R35348  10K  RESISTOR_0201  [0201]
R35349  10K  RESISTOR_0201  [0201]
R35350  10K  RESISTOR_0201  [0201]
R35351  10K  RESISTOR_0201  [0201]
R35352  10K  RESISTOR_0201  [0201]
R35353  10K  RESISTOR_0201  [0201]
R35354  10K  RESISTOR_0201  [0201]
R35355  10K  RESISTOR_0201  [0201]
R35356  10K  RESISTOR_0201  [0201]
R35357  10K  RESISTOR_0201  [0201]
R35358  10K  RESISTOR_0201  [0201]
R35359  10K  RESISTOR_0201  [0201]
R35360  10K  RESISTOR_0201  [0201]
R35361  10K  RESISTOR_0201  [0201]
R35362  10K  RESISTOR_0201  [0201]
R35363  10K  RESISTOR_0201  [0201]
R35364  10K  RESISTOR_0201  [0201]
R35365  10K  RESISTOR_0201  [0201]
R35366  10K  RESISTOR_0201  [0201]
R35367  10K  RESISTOR_0201  [0201]
R35368  10K  RESISTOR_0201  [0201]
R35369  10K  RESISTOR_0201  [0201]
R35370  10K  RESISTOR_0201  [0201]
R35371  10K  RESISTOR_0201  [0201]
R35372  10K  RESISTOR_0201  [0201]
R35373  10K  RESISTOR_0201  [0201]
R35374  10K  RESISTOR_0201  [0201]
R35375  10K  RESISTOR_0201  [0201]
R35376  10K  RESISTOR_0201  [0201]
R35377  10K  RESISTOR_0201  [0201]
R35378  10K  RESISTOR_0201  [0201]
R35379  10K  RESISTOR_0201  [0201]
R35380  10K  RESISTOR_0201  [0201]
R35381  10K  RESISTOR_0201  [0201]
R35382  10K  RESISTOR_0201  [0201]
R35383  10K  RESISTOR_0201  [0201]
R35384  10K  RESISTOR_0201  [0201]
R35385  10K  RESISTOR_0201  [0201]
R35386  10K  RESISTOR_0201  [0201]
R35387  10K  RESISTOR_0201  [0201]
R35388  10K  RESISTOR_0201  [0201]
R35389  10K  RESISTOR_0201  [0201]
R35390  10K  RESISTOR_0201  [0201]
R35391  10K  RESISTOR_0201  [0201]
R35392  10K  RESISTOR_0201  [0201]
R35393  10K  RESISTOR_0201  [0201]
R35394  10K  RESISTOR_0201  [0201]
R35395  10K  RESISTOR_0201  [0201]
R35396  10K  RESISTOR_0201  [0201]
R35397  10K  RESISTOR_0201  [0201]
R35398  10K  RESISTOR_0201  [0201]
R35399  10K  RESISTOR_0201  [0201]
R35400  10K  RESISTOR_0201  [0201]
R35401  10K  RESISTOR_0201  [0201]
R35402  10K  RESISTOR_0201  [0201]
R35403  10K  RESISTOR_0201  [0201]
R35404  10K  RESISTOR_0201  [0201]
R35405  10K  RESISTOR_0201  [0201]
R35406  10K  RESISTOR_0201  [0201]
R35407  10K  RESISTOR_0201  [0201]
R35408  10K  RESISTOR_0201  [0201]
R35409  10K  RESISTOR_0201  [0201]
R35410  10K  RESISTOR_0201  [0201]
R35411  10K  RESISTOR_0201  [0201]
R35412  10K  RESISTOR_0201  [0201]
R35413  10K  RESISTOR_0201  [0201]
R35414  10K  RESISTOR_0201  [0201]
R35415  10K  RESISTOR_0201  [0201]
R35416  10K  RESISTOR_0201  [0201]
R35417  10K  RESISTOR_0201  [0201]
R35418  10K  RESISTOR_0201  [0201]
R35419  10K  RESISTOR_0201  [0201]
R35420  10K  RESISTOR_0201  [0201]
R35421  10K  RESISTOR_0201  [0201]
R35422  10K  RESISTOR_0201  [0201]
R35423  10K  RESISTOR_0201  [0201]
R35424  10K  RESISTOR_0201  [0201]
R35425  10K  RESISTOR_0201  [0201]
R35426  10K  RESISTOR_0201  [0201]
R35427  10K  RESISTOR_0201  [0201]
R35428  10K  RESISTOR_0201  [0201]
R35429  10K  RESISTOR_0201  [0201]
R35430  10K  RESISTOR_0201  [0201]
R35431  10K  RESISTOR_0201  [0201]
R35432  10K  RESISTOR_0201  [0201]
R35433  10K  RESISTOR_0201  [0201]
R35434  10K  RESISTOR_0201  [0201]
R35435  10K  RESISTOR_0201  [0201]
R35436  10K  RESISTOR_0201  [0201]
R35437  10K  RESISTOR_0201  [0201]
R35438  10K  RESISTOR_0201  [0201]
R35439  10K  RESISTOR_0201  [0201]
R35440  10K  RESISTOR_0201  [0201]
R35441  10K  RESISTOR_0201  [0201]
R35442  10K  RESISTOR_0201  [0201]
R35443  10K  RESISTOR_0201  [0201]
R35444  10K  RESISTOR_0201  [0201]
R35445  10K  RESISTOR_0201  [0201]
R35446  10K  RESISTOR_0201  [0201]
R35447  10K  RESISTOR_0201  [0201]
R35448  10K  RESISTOR_0201  [0201]
R35449  10K  RESISTOR_0201  [0201]
R35450  10K  RESISTOR_0201  [0201]
R35451  10K  RESISTOR_0201  [0201]
R35452  10K  RESISTOR_0201  [0201]
R35453  10K  RESISTOR_0201  [0201]
R35454  10K  RESISTOR_0201  [0201]
R35455  10K  RESISTOR_0201  [0201]
R35456  10K  RESISTOR_0201  [0201]
R35457  10K  RESISTOR_0201  [0201]
R35458  10K  RESISTOR_0201  [0201]
R35459  10K  RESISTOR_0201  [0201]
R35460  10K  RESISTOR_0201  [0201]
R35461  10K  RESISTOR_0201  [0201]
R35462  10K  RESISTOR_0201  [0201]
R35463  10K  RESISTOR_0201  [0201]
R35464  10K  RESISTOR_0201  [0201]
R35465  10K  RESISTOR_0201  [0201]
R35466  10K  RESISTOR_0201  [0201]
R35467  10K  RESISTOR_0201  [0201]
R35468  10K  RESISTOR_0201  [0201]
R35469  10K  RESISTOR_0201  [0201]
R35470  10K  RESISTOR_0201  [0201]
R35471  10K  RESISTOR_0201  [0201]
R35472  10K  RESISTOR_0201  [0201]
R35473  10K  RESISTOR_0201  [0201]
R35474  10K  RESISTOR_0201  [0201]
R35475  10K  RESISTOR_0201  [0201]
R35476  10K  RESISTOR_0201  [0201]
R35477  10K  RESISTOR_0201  [0201]
R35478  10K  RESISTOR_0201  [0201]
R35479  10K  RESISTOR_0201  [0201]
R35480  10K  RESISTOR_0201  [0201]
R35481  10K  RESISTOR_0201  [0201]
R35482  10K  RESISTOR_0201  [0201]
R35483  10K  RESISTOR_0201  [0201]
R35484  10K  RESISTOR_0201  [0201]
R35485  10K  RESISTOR_0201  [0201]
R35486  10K  RESISTOR_0201  [0201]
R35487  10K  RESISTOR_0201  [0201]
R35488  10K  RESISTOR_0201  [0201]
R35489  10K  RESISTOR_0201  [0201]
R35490  10K  RESISTOR_0201  [0201]
R35491  10K  RESISTOR_0201  [0201]
R35492  10K  RESISTOR_0201  [0201]
R35493  10K  RESISTOR_0201  [0201]
R35494  10K  RESISTOR_0201  [0201]
R35495  10K  RESISTOR_0201  [0201]
R35496  10K  RESISTOR_0201  [0201]
R35497  10K  RESISTOR_0201  [0201]
R35498  10K  RESISTOR_0201  [0201]
R35499  10K  RESISTOR_0201  [0201]
R35500  10K  RESISTOR_0201  [0201]
R35501  10K  RESISTOR_0201  [0201]
R35502  10K  RESISTOR_0201  [0201]
R35503  10K  RESISTOR_0201  [0201]
R35504  10K  RESISTOR_0201  [0201]
R35505  10K  RESISTOR_0201  [0201]
R35506  10K  RESISTOR_0201  [0201]
R35507  10K  RESISTOR_0201  [0201]
R35508  10K  RESISTOR_0201  [0201]
R35509  10K  RESISTOR_0201  [0201]
R35510  10K  RESISTOR_0201  [0201]
R35511  10K  RESISTOR_0201  [0201]
R35512  10K  RESISTOR_0201  [0201]
R35513  10K  RESISTOR_0201  [0201]
R35514  10K  RESISTOR_0201  [0201]
R35515  10K  RESISTOR_0201  [0201]
R35516  10K  RESISTOR_0201  [0201]
R35517  10K  RESISTOR_0201  [0201]
R35518  10K  RESISTOR_0201  [0201]
R35519  10K  RESISTOR_0201  [0201]
R35520  10K  RESISTOR_0201  [0201]
R35521  10K  RESISTOR_0201  [0201]
R35522  10K  RESISTOR_0201  [0201]
R35523  10K  RESISTOR_0201  [0201]
R35524  10K  RESISTOR_0201  [0201]
R35525  10K  RESISTOR_0201  [0201]
R35526  10K  RESISTOR_0201  [0201]
R35527  10K  RESISTOR_0201  [0201]
R35528  10K  RESISTOR_0201  [0201]
R35529  10K  RESISTOR_0201  [0201]
R35530  10K  RESISTOR_0201  [0201]
R35531  10K  RESISTOR_0201  [0201]
R35532  10K  RESISTOR_0201  [0201]
R35533  10K  RESISTOR_0201  [0201]
R35534  10K  RESISTOR_0201  [0201]
R35535  10K  RESISTOR_0201  [0201]
R35536  10K  RESISTOR_0201  [0201]
R35537  10K  RESISTOR_0201  [0201]
R35538  10K  RESISTOR_0201  [0201]
R35539  10K  RESISTOR_0201  [0201]
R35540  10K  RESISTOR_0201  [0201]
R35541  10K  RESISTOR_0201  [0201]
R35542  10K  RESISTOR_0201  [0201]
R35543  10K  RESISTOR_0201  [0201]
R35544  10K  RESISTOR_0201  [0201]
R35545  10K  RESISTOR_0201  [0201]
R35546  10K  RESISTOR_0201  [0201]
R35547  10K  RESISTOR_0201  [0201]
R35548  10K  RESISTOR_0201  [0201]
R35549  10K  RESISTOR_0201  [0201]
R35550  10K  RESISTOR_0201  [0201]
R35551  10K  RESISTOR_0201  [0201]
R35552  10K  RESISTOR_0201  [0201]
R35553  10K  RESISTOR_0201  [0201]
R35554  10K  RESISTOR_0201  [0201]
R35555  10K  RESISTOR_0201  [0201]
R35556  10K  RESISTOR_0201  [0201]
R35557  10K  RESISTOR_0201  [0201]
R35558  10K  RESISTOR_0201  [0201]
R35559  10K  RESISTOR_0201  [0201]
R35560  10K  RESISTOR_0201  [0201]
R35561  10K  RESISTOR_0201  [0201]
R35562  10K  RESISTOR_0201  [0201]
R35563  10K  RESISTOR_0201  [0201]
R35564  10K  RESISTOR_0201  [0201]
R35565  10K  RESISTOR_0201  [0201]
R35566  10K  RESISTOR_0201  [0201]
R35567  10K  RESISTOR_0201  [0201]
R35568  10K  RESISTOR_0201  [0201]
R35569  10K  RESISTOR_0201  [0201]
R35570  10K  RESISTOR_0201  [0201]
R35571  10K  RESISTOR_0201  [0201]
R35572  10K  RESISTOR_0201  [0201]
R35573  10K  RESISTOR_0201  [0201]
R35574  10K  RESISTOR_0201  [0201]
R35575  10K  RESISTOR_0201  [0201]
R35576  10K  RESISTOR_0201  [0201]
R35577  10K  RESISTOR_0201  [0201]
R35578  10K  RESISTOR_0201  [0201]
R35579  10K  RESISTOR_0201  [0201]
R35580  10K  RESISTOR_0201  [0201]
R35581  10K  RESISTOR_0201  [0201]
R35582  10K  RESISTOR_0201  [0201]
R35583  10K  RESISTOR_0201  [0201]
R35584  10K  RESISTOR_0201  [0201]
R35585  10K  RESISTOR_0201  [0201]
R35586  10K  RESISTOR_0201  [0201]
R35587  10K  RESISTOR_0201  [0201]
R35588  10K  RESISTOR_0201  [0201]
R35589  10K  RESISTOR_0201  [0201]
R35590  10K  RESISTOR_0201  [0201]
R35591  10K  RESISTOR_0201  [0201]
R35592  10K  RESISTOR_0201  [0201]
R35593  10K  RESISTOR_0201  [0201]
R35594  10K  RESISTOR_0201  [0201]
R35595  10K  RESISTOR_0201  [0201]
R35596  10K  RESISTOR_0201  [0201]
R35597  10K  RESISTOR_0201  [0201]
R35598  10K  RESISTOR_0201  [0201]
R35599  10K  RESISTOR_0201  [0201]
R35600  10K  RESISTOR_0201  [0201]
R35601  10K  RESISTOR_0201  [0201]
R35602  10K  RESISTOR_0201  [0201]
R35603  10K  RESISTOR_0201  [0201]
R35604  10K  RESISTOR_0201  [0201]
R35605  10K  RESISTOR_0201  [0201]
R35606  10K  RESISTOR_0201  [0201]
R35607  10K  RESISTOR_0201  [0201]
R35608  10K  RESISTOR_0201  [0201]
R35609  10K  RESISTOR_0201  [0201]
R35610  10K  RESISTOR_0201  [0201]
R35611  10K  RESISTOR_0201  [0201]
R35612  10K  RESISTOR_0201  [0201]
R35613  10K  RESISTOR_0201  [0201]
R35614  10K  RESISTOR_0201  [0201]
R35615  10K  RESISTOR_0201  [0201]
R35616  10K  RESISTOR_0201  [0201]
R35617  10K  RESISTOR_0201  [0201]
R35618  10K  RESISTOR_0201  [0201]
R35619  10K  RESISTOR_0201  [0201]
R35620  10K  RESISTOR_0201  [0201]
R35621  10K  RESISTOR_0201  [0201]
R35622  10K  RESISTOR_0201  [0201]
R35623  10K  RESISTOR_0201  [0201]
R35624  10K  RESISTOR_0201  [0201]
R35625  10K  RESISTOR_0201  [0201]
R35626  10K  RESISTOR_0201  [0201]
R35627  10K  RESISTOR_0201  [0201]
R35628  10K  RESISTOR_0201  [0201]
R35629  10K  RESISTOR_0201  [0201]
R35630  10K  RESISTOR_0201  [0201]
R35631  10K  RESISTOR_0201  [0201]
R35632  10K  RESISTOR_0201  [0201]
R35633  10K  RESISTOR_0201  [0201]
R35634  10K  RESISTOR_0201  [0201]
R35635  10K  RESISTOR_0201  [0201]
R35636  10K  RESISTOR_0201  [0201]
R35637  10K  RESISTOR_0201  [0201]
R35638  10K  RESISTOR_0201  [0201]
R35639  10K  RESISTOR_0201  [0201]
R35640  10K  RESISTOR_0201  [0201]
R35641  10K  RESISTOR_0201  [0201]
R35642  10K  RESISTOR_0201  [0201]
R35643  10K  RESISTOR_0201  [0201]
R35644  10K  RESISTOR_0201  [0201]
R35645  10K  RESISTOR_0201  [0201]
R35646  10K  RESISTOR_0201  [0201]
R35647  10K  RESISTOR_0201  [0201]
R35648  10K  RESISTOR_0201  [0201]
R35649  10K  RESISTOR_0201  [0201]
R35650  10K  RESISTOR_0201  [0201]
R35651  10K  RESISTOR_0201  [0201]
R35652  10K  RESISTOR_0201  [0201]
R35653  10K  RESISTOR_0201  [0201]
R35654  10K  RESISTOR_0201  [0201]
R35655  10K  RESISTOR_0201  [0201]
R35656  10K  RESISTOR_0201  [0201]
R35657  10K  RESISTOR_0201  [0201]
R35658  10K  RESISTOR_0201  [0201]
R35659  10K  RESISTOR_0201  [0201]
R35660  10K  RESISTOR_0201  [0201]
R35661  10K  RESISTOR_0201  [0201]
R35662  10K  RESISTOR_0201  [0201]
R35663  10K  RESISTOR_0201  [0201]
R35664  10K  RESISTOR_0201  [0201]
R35665  10K  RESISTOR_0201  [0201]
R35666  10K  RESISTOR_0201  [0201]
R35667  10K  RESISTOR_0201  [0201]
R35668  10K  RESISTOR_0201  [0201]
R35669  10K  RESISTOR_0201  [0201]
R35670  10K  RESISTOR_0201  [0201]
R35671  10K  RESISTOR_0201  [0201]
R35672  10K  RESISTOR_0201  [0201]
R35673  10K  RESISTOR_0201  [0201]
R35674  10K  RESISTOR_0201  [0201]
R35675  10K  RESISTOR_0201  [0201]
R35676  10K  RESISTOR_0201  [0201]
R35677  10K  RESISTOR_0201  [0201]
R35678  10K  RESISTOR_0201  [0201]
R35679  10K  RESISTOR_0201  [0201]
R35680  10K  RESISTOR_0201  [0201]
R35681  10K  RESISTOR_0201  [0201]
R35682  10K  RESISTOR_0201  [0201]
R35683  10K  RESISTOR_0201  [0201]
R35684  10K  RESISTOR_0201  [0201]
R35685  10K  RESISTOR_0201  [0201]
R35686  10K  RESISTOR_0201  [0201]
R35687  10K  RESISTOR_0201  [0201]
R35688  10K  RESISTOR_0201  [0201]
R35689  10K  RESISTOR_0201  [0201]
R35690  10K  RESISTOR_0201  [0201]
R35691  10K  RESISTOR_0201  [0201]
R35692  10K  RESISTOR_0201  [0201]
R35693  10K  RESISTOR_0201  [0201]
R35694  10K  RESISTOR_0201  [0201]
R35695  10K  RESISTOR_0201  [0201]
R35696  10K  RESISTOR_0201  [0201]
R35697  10K  RESISTOR_0201  [0201]
R35698  10K  RESISTOR_0201  [0201]
R35699  10K  RESISTOR_0201  [0201]
R35700  10K  RESISTOR_0201  [0201]
R35701  10K  RESISTOR_0201  [0201]
R35702  10K  RESISTOR_0201  [0201]
R35703  10K  RESISTOR_0201  [0201]
R35704  10K  RESISTOR_0201  [0201]
R35705  10K  RESISTOR_0201  [0201]
R35706  10K  RESISTOR_0201  [0201]
R35707  10K  RESISTOR_0201  [0201]
R35708  10K  RESISTOR_0201  [0201]
R35709  10K  RESISTOR_0201  [0201]
R35710  10K  RESISTOR_0201  [0201]
R35711  10K  RESISTOR_0201  [0201]
R35712  10K  RESISTOR_0201  [0201]
R35713  10K  RESISTOR_0201  [0201]
R35714  10K  RESISTOR_0201  [0201]
R35715  10K  RESISTOR_0201  [0201]
R35716  10K  RESISTOR_0201  [0201]
R35717  10K  RESISTOR_0201  [0201]
R35718  10K  RESISTOR_0201  [0201]
R35719  10K  RESISTOR_0201  [0201]
R35720  10K  RESISTOR_0201  [0201]
R35721  10K  RESISTOR_0201  [0201]
R35722  10K  RESISTOR_0201  [0201]
R35723  10K  RESISTOR_0201  [0201]
R35724  10K  RESISTOR_0201  [0201]
R35725  10K  RESISTOR_0201  [0201]
R35726  10K  RESISTOR_0201  [0201]
R35727  10K  RESISTOR_0201  [0201]
R35728  10K  RESISTOR_0201  [0201]
R35729  10K  RESISTOR_0201  [0201]
R35730  10K  RESISTOR_0201  [0201]
R35731  10K  RESISTOR_0201  [0201]
R35732  10K  RESISTOR_0201  [0201]
R35733  10K  RESISTOR_0201  [0201]
R35734  10K  RESISTOR_0201  [0201]
R35735  10K  RESISTOR_0201  [0201]
R35736  10K  RESISTOR_0201  [0201]
R35737  10K  RESISTOR_0201  [0201]
R35738  10K  RESISTOR_0201  [0201]
R35739  10K  RESISTOR_0201  [0201]
R35740  10K  RESISTOR_0201  [0201]
R35741  10K  RESISTOR_0201  [0201]
R35742  10K  RESISTOR_0201  [0201]
R35743  10K  RESISTOR_0201  [0201]
R35744  10K  RESISTOR_0201  [0201]
R35745  10K  RESISTOR_0201  [0201]
R35746  10K  RESISTOR_0201  [0201]
R35747  10K  RESISTOR_0201  [0201]
R35748  10K  RESISTOR_0201  [0201]
R35749  10K  RESISTOR_0201  [0201]
R35750  10K  RESISTOR_0201  [0201]
R35751  10K  RESISTOR_0201  [0201]
R35752  10K  RESISTOR_0201  [0201]
R35753  10K  RESISTOR_0201  [0201]
R35754  10K  RESISTOR_0201  [0201]
R35755  10K  RESISTOR_0201  [0201]
R35756  10K  RESISTOR_0201  [0201]
R35757  10K  RESISTOR_0201  [0201]
R35758  10K  RESISTOR_0201  [0201]
R35759  10K  RESISTOR_0201  [0201]
R35760  10K  RESISTOR_0201  [0201]
R35761  10K  RESISTOR_0201  [0201]
R35762  10K  RESISTOR_0201  [0201]
R35763  10K  RESISTOR_0201  [0201]
R35764  10K  RESISTOR_0201  [0201]
R35765  10K  RESISTOR_0201  [0201]
R35766  10K  RESISTOR_0201  [0201]
R35767  10K  RESISTOR_0201  [0201]
R35768  10K  RESISTOR_0201  [0201]
R35769  10K  RESISTOR_0201  [0201]
R35770  10K  RESISTOR_0201  [0201]
R35771  10K  RESISTOR_0201  [0201]
R35772  10K  RESISTOR_0201  [0201]
R35773  10K  RESISTOR_0201  [0201]
R35774  10K  RESISTOR_0201  [0201]
R35775  10K  RESISTOR_0201  [0201]
R35776  10K  RESISTOR_0201  [0201]
R35777  10K  RESISTOR_0201  [0201]
R35778  10K  RESISTOR_0201  [0201]
R35779  10K  RESISTOR_0201  [0201]
R35780  10K  RESISTOR_0201  [0201]
R35781  10K  RESISTOR_0201  [0201]
R35782  10K  RESISTOR_0201  [0201]
R35783  10K  RESISTOR_0201  [0201]
R35784  10K  RESISTOR_0201  [0201]
R35785  10K  RESISTOR_0201  [0201]
R35786  10K  RESISTOR_0201  [0201]
R35787  10K  RESISTOR_0201  [0201]
R35788  10K  RESISTOR_0201  [0201]
R35789  10K  RESISTOR_0201  [0201]
R35790  10K  RESISTOR_0201  [0201]
R35791  10K  RESISTOR_0201  [0201]
R35792  10K  RESISTOR_0201  [0201]
R35793  10K  RESISTOR_0201  [0201]
R35794  10K  RESISTOR_0201  [0201]
R35795  10K  RESISTOR_0201  [0201]
R35796  10K  RESISTOR_0201  [0201]
R35797  10K  RESISTOR_0201  [0201]